# Altium schematic sheet FMCP.SchDoc
size 420 x 297 mm; SheetNumber: 2; SheetTotal: 11; ModifiedBy: -; CheckedDate: -; Title2: Title 2; DivGrp: WUT ISE; Designer: G.Kasprowicz
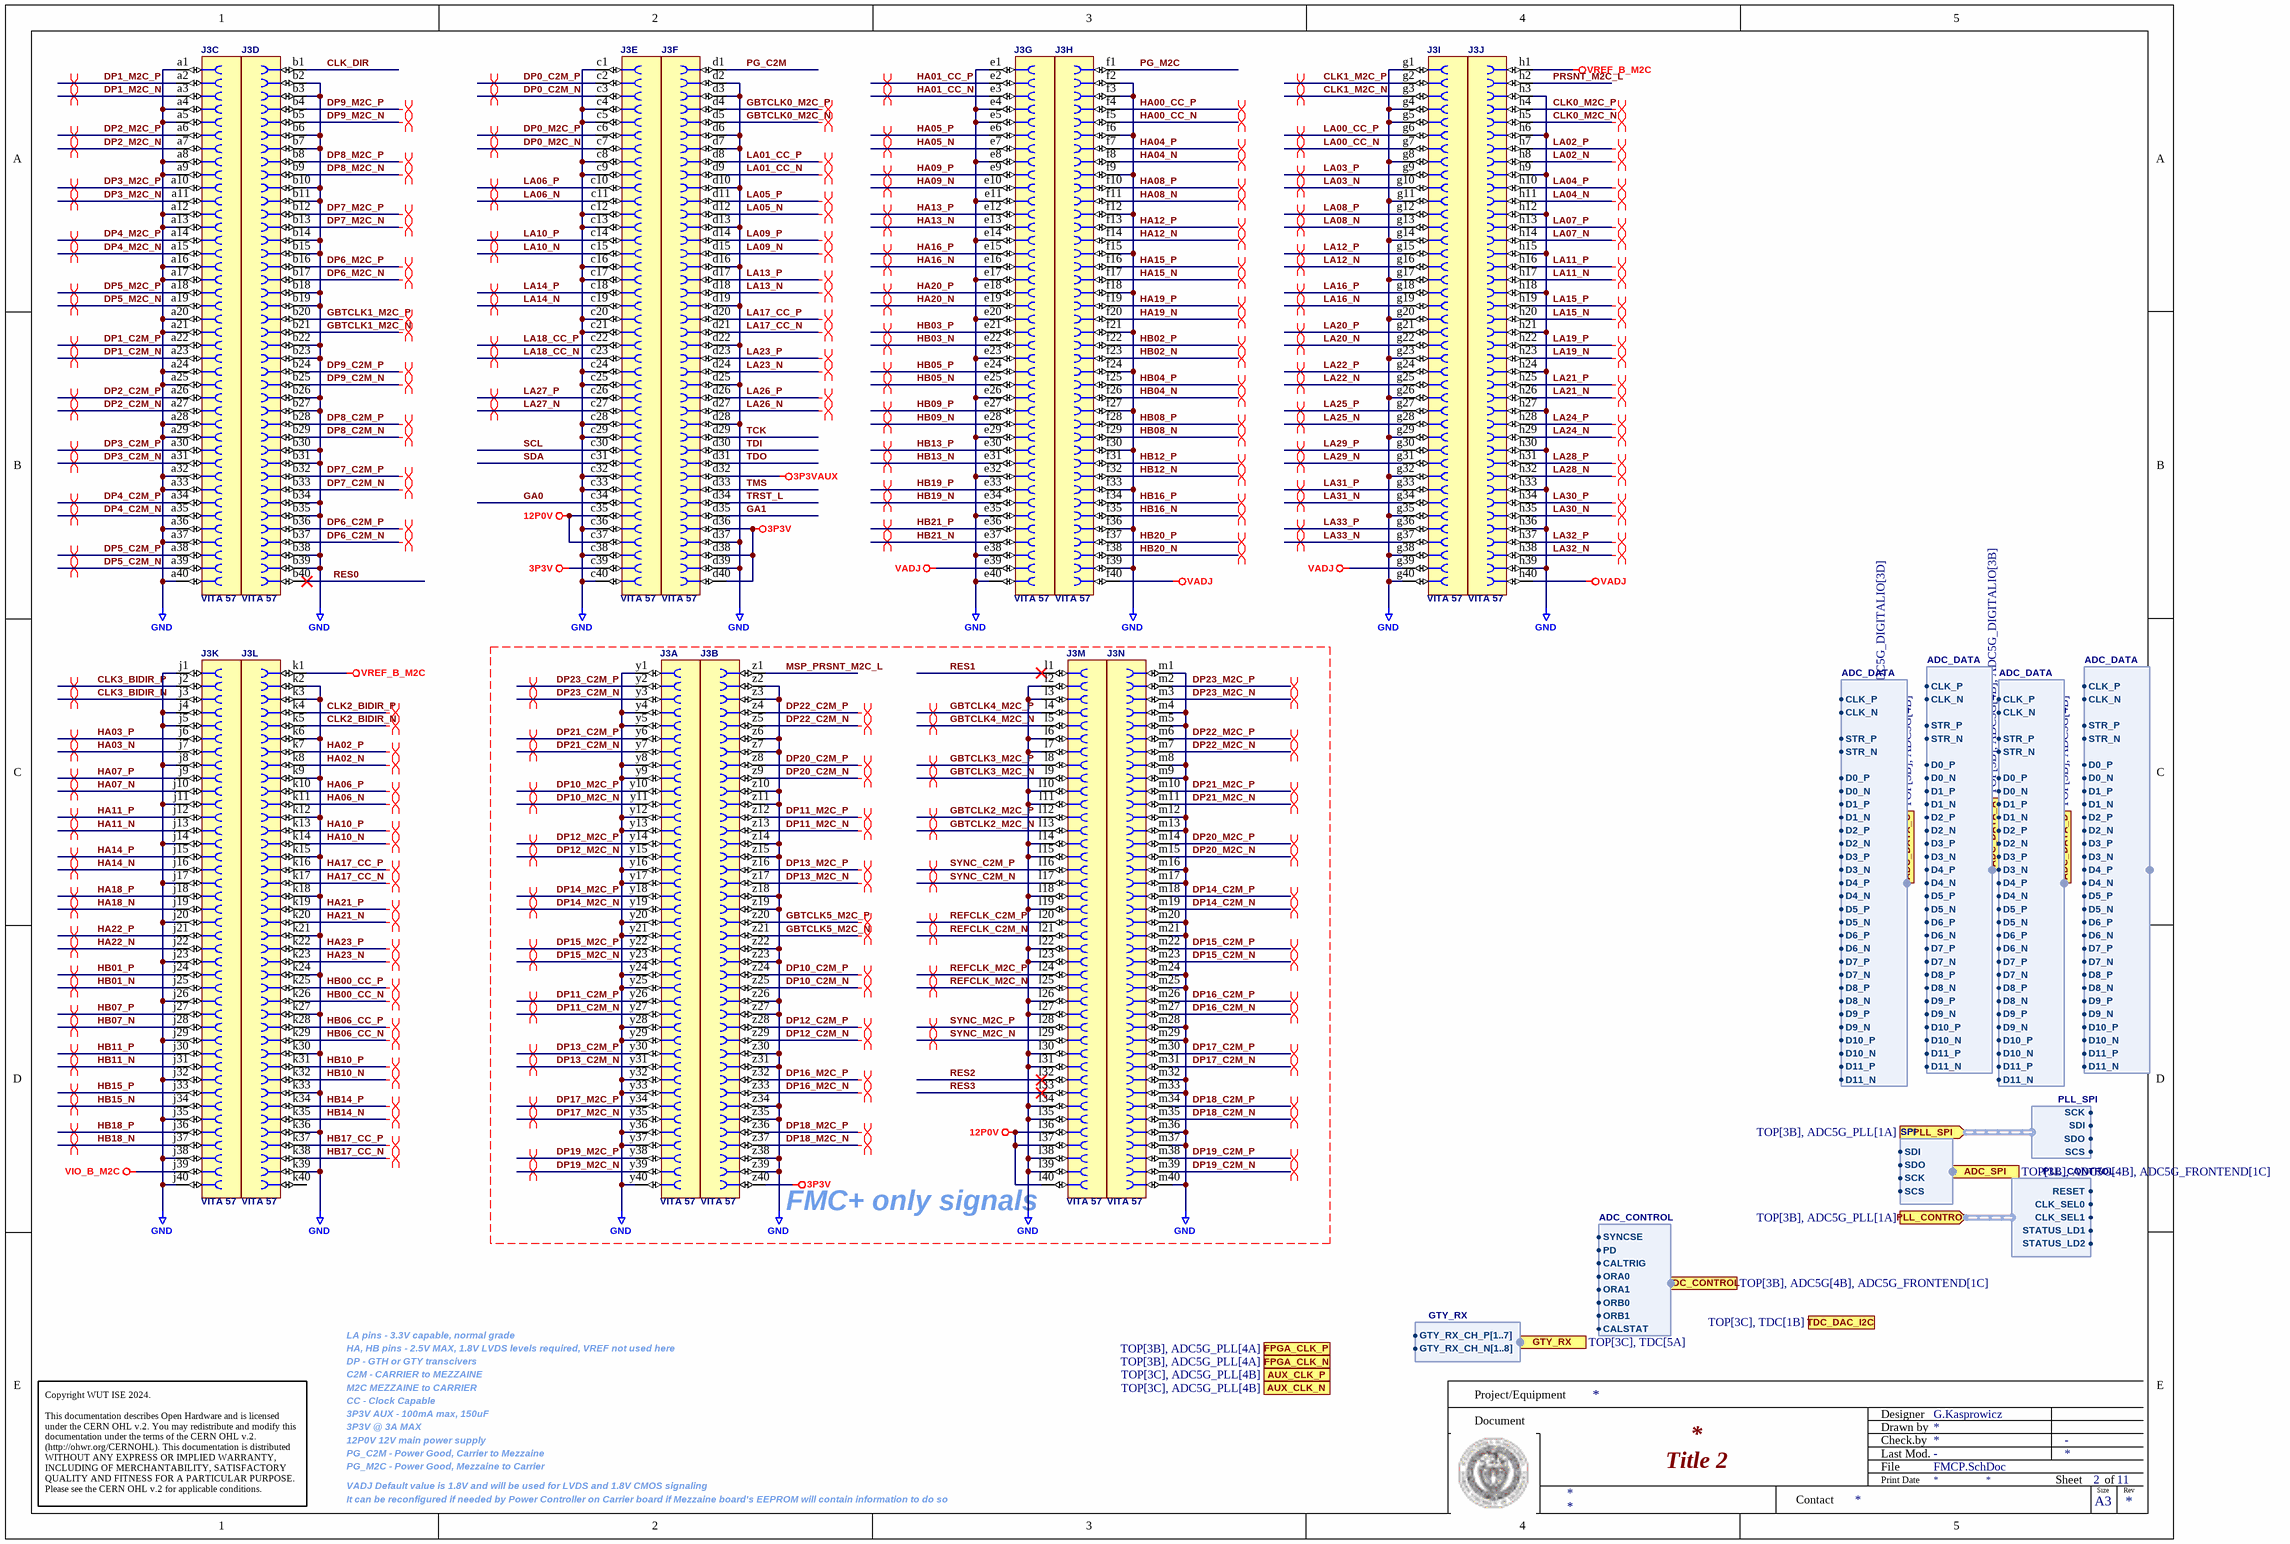
[diagram p0: FMCP.SchDoc]

## Parts
J3  VITA 57  [SAMTEC_ASP-184329-01]  (parts A,B,C,D,E,F,G,H,I,J,K,L,M,N of 14)

## Ports
ADC_CONTROL (in, harness ADC_CONTROL, see TOP[3B], ADC5G[4B], ADC5G_FRONTEND[1C]), ADC_DATA_A (in, harness ADC_DATA, see TOP[3B], ADC5G[4B], ADC5G_DIGITALIO[3B]), ADC_DATA_B (in, harness ADC_DATA, see TOP[3B], ADC5G[4B], ADC5G_DIGITALIO[3D]), ADC_DATA_C (in, harness ADC_DATA, see TOP[3B], ADC5G[4B]), ADC_DATA_D (in, harness ADC_DATA, see TOP[3B], ADC5G[4B]), ADC_SPI (in, harness SPI, see TOP[3B], ADC5G[4B], ADC5G_FRONTEND[1C]), AUX_CLK_N (in, see TOP[3C], ADC5G_PLL[4B]), AUX_CLK_P (in, see TOP[3C], ADC5G_PLL[4B]), FPGA_CLK_N (in, see TOP[3B], ADC5G_PLL[4A]), FPGA_CLK_P (in, see TOP[3B], ADC5G_PLL[4A]), GTY_RX (in, harness GTY_RX, see TOP[3C], TDC[5A]), PLL_CONTROL (in, harness PLL_CONTROL, see TOP[3B], ADC5G_PLL[1A]), PLL_SPI (in, harness PLL_SPI, see TOP[3B], ADC5G_PLL[1A]), TDC_DAC_I2C (harness I2C, see TOP[3C], TDC[1B])

## Harnesses
ADC_DATA: CLK_P, CLK_N, STR_P, STR_N, D0_P, D1_P, D2_P, D3_P, D4_P, D5_P, D6_P, D7_P, D8_P, D9_P, D10_P, D11_P, D11_N, D10_N, D9_N, D8_N, D7_N, D6_N, D5_N, D4_N, D3_N, D2_N, D1_N, D0_N
SPI: SDI, SDO, SCK, SCS
ADC_CONTROL: SYNCSE, PD, CALTRIG, ORA0, ORA1, ORB0, ORB1, CALSTAT
PLL_SPI: SCK, SDI, SDO, SCS
PLL_CONTROL: RESET, CLK_SEL0, CLK_SEL1, STATUS_LD1, STATUS_LD2
GTY_RX: GTY_RX_CH_P[1..7], GTY_RX_CH_N[1..8]

## Nets
3P3V: J3.c39 J3.d36 J3.d38 J3.d40 J3.z40
3P3VAUX: J3.d32
12P0V: J3.c35 J3.c37 J3.l36 J3.l37 J3.l40
GND: J3.a1 J3.a4 J3.a5 J3.a8 J3.a9 J3.a12 J3.a13 J3.a16 J3.a17 J3.a20 J3.a21 J3.a24 J3.a25 J3.a28 J3.a29 J3.a32 J3.a33 J3.a36 J3.a37 J3.a40 J3.b2 J3.b3 J3.b6 J3.b7 J3.b10 J3.b11 J3.b14 J3.b15 J3.b18 J3.b19 J3.b22 J3.b23 J3.b26 J3.b27 J3.b30 J3.b31 J3.b34 J3.b35 J3.b38 J3.b39 J3.c1 J3.c4 J3.c5 J3.c8 J3.c9 J3.c12 J3.c13 J3.c16 J3.c17 J3.c20 J3.c21 J3.c24 J3.c25 J3.c28 J3.c29 J3.c32 J3.c33 J3.c36 J3.c38 J3.c40 J3.d2 J3.d3 J3.d6 J3.d7 J3.d10 J3.d13 J3.d16 J3.d19 J3.d22 J3.d25 J3.d28 J3.d37 J3.d39 J3.e1 J3.e4 J3.e5 J3.e8 J3.e11 J3.e14 J3.e17 J3.e20 J3.e23 J3.e26 J3.e29 J3.e32 J3.e35 J3.e38 J3.e40 J3.f2 J3.f3 J3.f6 J3.f9 J3.f12 J3.f15 J3.f18 J3.f21 J3.f24 J3.f27 J3.f30 J3.f33 J3.f36 J3.f39 J3.g1 J3.g4 J3.g5 J3.g8 J3.g11 J3.g14 J3.g17 J3.g20 J3.g23 J3.g26 J3.g29 J3.g32 J3.g35 J3.g38 J3.g40 J3.h3 J3.h6 J3.h9 J3.h12 J3.h15 J3.h18 J3.h21 J3.h24 J3.h27 J3.h30 J3.h33 J3.h36 J3.h39 J3.j1 J3.j4 J3.j5 J3.j8 J3.j11 J3.j14 J3.j17 J3.j20 J3.j23 J3.j26 J3.j29 J3.j32 J3.j35 J3.j38 J3.j40 J3.k2 J3.k3 J3.k6 J3.k9 J3.k12 J3.k15 J3.k18 J3.k21 J3.k24 J3.k27 J3.k30 J3.k33 J3.k36 J3.k39 J3.l2 J3.l3 J3.l6 J3.l7 J3.l10 J3.l11 J3.l14 J3.l15 J3.l18 J3.l19 J3.l22 J3.l23 J3.l26 J3.l27 J3.l30 J3.l31 J3.l34 J3.l35 J3.l38 J3.l39 J3.m1 J3.m4 J3.m5 J3.m8 J3.m9 J3.m12 J3.m13 J3.m16 J3.m17 J3.m20 J3.m21 J3.m24 J3.m25 J3.m28 J3.m29 J3.m32 J3.m33 J3.m36 J3.m37 J3.m40 J3.y1 J3.y4 J3.y5 J3.y8 J3.y9 J3.y12 J3.y13 J3.y16 J3.y17 J3.y20 J3.y21 J3.y24 J3.y25 J3.y28 J3.y29 J3.y32 J3.y33 J3.y36 J3.y37 J3.y40 J3.z2 J3.z3 J3.z6 J3.z7 J3.z10 J3.z11 J3.z14 J3.z15 J3.z18 J3.z19 J3.z22 J3.z23 J3.z26 J3.z27 J3.z30 J3.z31 J3.z34 J3.z35 J3.z38 J3.z39
VADJ: J3.e39 J3.f40 J3.g39 J3.h40
VIO_B_M2C: J3.j39
VREF_B_M2C: J3.h1 J3.k1
CLK0_M2C_N: J3.h5
CLK0_M2C_P: J3.h4
CLK1_M2C_N: J3.g3
CLK1_M2C_P: J3.g2
CLK2_BIDIR_N: J3.k5
CLK2_BIDIR_P: J3.k4
CLK3_BIDIR_N: J3.j3
CLK3_BIDIR_P: J3.j2
CLK_DIR: J3.b1
DP0_C2M_N: J3.c3
DP0_C2M_P: J3.c2
DP0_M2C_N: J3.c7
DP0_M2C_P: J3.c6
DP1_C2M_N: J3.a23
DP1_C2M_P: J3.a22
DP1_M2C_N: J3.a3
DP1_M2C_P: J3.a2
DP2_C2M_N: J3.a27
DP2_C2M_P: J3.a26
DP2_M2C_N: J3.a7
DP2_M2C_P: J3.a6
DP3_C2M_N: J3.a31
DP3_C2M_P: J3.a30
DP3_M2C_N: J3.a11
DP3_M2C_P: J3.a10
DP4_C2M_N: J3.a35
DP4_C2M_P: J3.a34
DP4_M2C_N: J3.a15
DP4_M2C_P: J3.a14
DP5_C2M_N: J3.a39
DP5_C2M_P: J3.a38
DP5_M2C_N: J3.a19
DP5_M2C_P: J3.a18
DP6_C2M_N: J3.b37
DP6_C2M_P: J3.b36
DP6_M2C_N: J3.b17
DP6_M2C_P: J3.b16
DP7_C2M_N: J3.b33
DP7_C2M_P: J3.b32
DP7_M2C_N: J3.b13
DP7_M2C_P: J3.b12
DP8_C2M_N: J3.b29
DP8_C2M_P: J3.b28
DP8_M2C_N: J3.b9
DP8_M2C_P: J3.b8
DP9_C2M_N: J3.b25
DP9_C2M_P: J3.b24
DP9_M2C_N: J3.b5
DP9_M2C_P: J3.b4
DP10_C2M_N: J3.z25
DP10_C2M_P: J3.z24
DP10_M2C_N: J3.y11
DP10_M2C_P: J3.y10
DP11_C2M_N: J3.y27
DP11_C2M_P: J3.y26
DP11_M2C_N: J3.z13
DP11_M2C_P: J3.z12
DP12_C2M_N: J3.z29
DP12_C2M_P: J3.z28
DP12_M2C_N: J3.y15
DP12_M2C_P: J3.y14
DP13_C2M_N: J3.y31
DP13_C2M_P: J3.y30
DP13_M2C_N: J3.z17
DP13_M2C_P: J3.z16
DP14_C2M_N: J3.m19
DP14_C2M_P: J3.m18
DP14_M2C_N: J3.y19
DP14_M2C_P: J3.y18
DP15_C2M_N: J3.m23
DP15_C2M_P: J3.m22
DP15_M2C_N: J3.y23
DP15_M2C_P: J3.y22
DP16_C2M_N: J3.m27
DP16_C2M_P: J3.m26
DP16_M2C_N: J3.z33
DP16_M2C_P: J3.z32
DP17_C2M_N: J3.m31
DP17_C2M_P: J3.m30
DP17_M2C_N: J3.y35
DP17_M2C_P: J3.y34
DP18_C2M_N: J3.m35
DP18_C2M_P: J3.m34
DP18_M2C_N: J3.z37
DP18_M2C_P: J3.z36
DP19_C2M_N: J3.m39
DP19_C2M_P: J3.m38
DP19_M2C_N: J3.y39
DP19_M2C_P: J3.y38
DP20_C2M_N: J3.z9
DP20_C2M_P: J3.z8
DP20_M2C_N: J3.m15
DP20_M2C_P: J3.m14
DP21_C2M_N: J3.y7
DP21_C2M_P: J3.y6
DP21_M2C_N: J3.m11
DP21_M2C_P: J3.m10
DP22_C2M_N: J3.z5
DP22_C2M_P: J3.z4
DP22_M2C_N: J3.m7
DP22_M2C_P: J3.m6
DP23_C2M_N: J3.y3
DP23_C2M_P: J3.y2
DP23_M2C_N: J3.m3
DP23_M2C_P: J3.m2
GA0: J3.c34
GA1: J3.d35
GBTCLK0_M2C_N: J3.d5
GBTCLK0_M2C_P: J3.d4
GBTCLK1_M2C_N: J3.b21
GBTCLK1_M2C_P: J3.b20
GBTCLK2_M2C_N: J3.l13
GBTCLK2_M2C_P: J3.l12
GBTCLK3_M2C_N: J3.l9
GBTCLK3_M2C_P: J3.l8
GBTCLK4_M2C_N: J3.l5
GBTCLK4_M2C_P: J3.l4
GBTCLK5_M2C_N: J3.z21
GBTCLK5_M2C_P: J3.z20
HA00_CC_N: J3.f5
HA00_CC_P: J3.f4
HA01_CC_N: J3.e3
HA01_CC_P: J3.e2
HA02_N: J3.k8
HA02_P: J3.k7
HA03_N: J3.j7
HA03_P: J3.j6
HA04_N: J3.f8
HA04_P: J3.f7
HA05_N: J3.e7
HA05_P: J3.e6
HA06_N: J3.k11
HA06_P: J3.k10
HA07_N: J3.j10
HA07_P: J3.j9
HA08_N: J3.f11
HA08_P: J3.f10
HA09_N: J3.e10
HA09_P: J3.e9
HA10_N: J3.k14
HA10_P: J3.k13
HA11_N: J3.j13
HA11_P: J3.j12
HA12_N: J3.f14
HA12_P: J3.f13
HA13_N: J3.e13
HA13_P: J3.e12
HA14_N: J3.j16
HA14_P: J3.j15
HA15_N: J3.f17
HA15_P: J3.f16
HA16_N: J3.e16
HA16_P: J3.e15
HA17_CC_N: J3.k17
HA17_CC_P: J3.k16
HA18_N: J3.j19
HA18_P: J3.j18
HA19_N: J3.f20
HA19_P: J3.f19
HA20_N: J3.e19
HA20_P: J3.e18
HA21_N: J3.k20
HA21_P: J3.k19
HA22_N: J3.j22
HA22_P: J3.j21
HA23_N: J3.k23
HA23_P: J3.k22
HB00_CC_N: J3.k26
HB00_CC_P: J3.k25
HB01_N: J3.j25
HB01_P: J3.j24
HB02_N: J3.f23
HB02_P: J3.f22
HB03_N: J3.e22
HB03_P: J3.e21
HB04_N: J3.f26
HB04_P: J3.f25
HB05_N: J3.e25
HB05_P: J3.e24
HB06_CC_N: J3.k29
HB06_CC_P: J3.k28
HB07_N: J3.j28
HB07_P: J3.j27
HB08_N: J3.f29
HB08_P: J3.f28
HB09_N: J3.e28
HB09_P: J3.e27
HB10_N: J3.k32
HB10_P: J3.k31
HB11_N: J3.j31
HB11_P: J3.j30
HB12_N: J3.f32
HB12_P: J3.f31
HB13_N: J3.e31
HB13_P: J3.e30
HB14_N: J3.k35
HB14_P: J3.k34
HB15_N: J3.j34
HB15_P: J3.j33
HB16_N: J3.f35
HB16_P: J3.f34
HB17_CC_N: J3.k38
HB17_CC_P: J3.k37
HB18_N: J3.j37
HB18_P: J3.j36
HB19_N: J3.e34
HB19_P: J3.e33
HB20_N: J3.f38
HB20_P: J3.f37
HB21_N: J3.e37
HB21_P: J3.e36
LA00_CC_N: J3.g7
LA00_CC_P: J3.g6
LA01_CC_N: J3.d9
LA01_CC_P: J3.d8
LA02_N: J3.h8
LA02_P: J3.h7
LA03_N: J3.g10
LA03_P: J3.g9
LA04_N: J3.h11
LA04_P: J3.h10
LA05_N: J3.d12
LA05_P: J3.d11
LA06_N: J3.c11
LA06_P: J3.c10
LA07_N: J3.h14
LA07_P: J3.h13
LA08_N: J3.g13
LA08_P: J3.g12
LA09_N: J3.d15
LA09_P: J3.d14
LA10_N: J3.c15
LA10_P: J3.c14
LA11_N: J3.h17
LA11_P: J3.h16
LA12_N: J3.g16
LA12_P: J3.g15
LA13_N: J3.d18
LA13_P: J3.d17
LA14_N: J3.c19
LA14_P: J3.c18
LA15_N: J3.h20
LA15_P: J3.h19
LA16_N: J3.g19
LA16_P: J3.g18
LA17_CC_N: J3.d21
LA17_CC_P: J3.d20
LA18_CC_N: J3.c23
LA18_CC_P: J3.c22
LA19_N: J3.h23
LA19_P: J3.h22
LA20_N: J3.g22
LA20_P: J3.g21
LA21_N: J3.h26
LA21_P: J3.h25
LA22_N: J3.g25
LA22_P: J3.g24
LA23_N: J3.d24
LA23_P: J3.d23
LA24_N: J3.h29
LA24_P: J3.h28
LA25_N: J3.g28
LA25_P: J3.g27
LA26_N: J3.d27
LA26_P: J3.d26
LA27_N: J3.c27
LA27_P: J3.c26
LA28_N: J3.h32
LA28_P: J3.h31
LA29_N: J3.g31
LA29_P: J3.g30
LA30_N: J3.h35
LA30_P: J3.h34
LA31_N: J3.g34
LA31_P: J3.g33
LA32_N: J3.h38
LA32_P: J3.h37
LA33_N: J3.g37
LA33_P: J3.g36
MSP_PRSNT_M2C_L: J3.z1
PG_C2M: J3.d1
PG_M2C: J3.f1
PRSNT_M2C_L: J3.h2
REFCLK_C2M_N: J3.l21
REFCLK_C2M_P: J3.l20
REFCLK_M2C_N: J3.l25
REFCLK_M2C_P: J3.l24
RES0: J3.b40
RES1: J3.l1
RES2: J3.l32
RES3: J3.l33
SCL: J3.c30
SDA: J3.c31
SYNC_C2M_N: J3.l17
SYNC_C2M_P: J3.l16
SYNC_M2C_N: J3.l29
SYNC_M2C_P: J3.l28
TCK: J3.d29
TDI: J3.d30
TDO: J3.d31
TMS: J3.d33
TRST_L: J3.d34

Not connected (* = marked no-connect by the designer): J3 k40

## Layout directives
differential pair: CLK0_M2C_N, CLK0_M2C_P, CLK1_M2C_N, CLK1_M2C_P, CLK2_BIDIR_N, CLK2_BIDIR_P, CLK3_BIDIR_N, CLK3_BIDIR_P, DP0_C2M_N, DP0_C2M_P, DP0_M2C_N, DP0_M2C_P, DP1_C2M_N, DP1_C2M_P, DP1_M2C_N, DP1_M2C_P, DP2_C2M_N, DP2_C2M_P, DP2_M2C_N, DP2_M2C_P, DP3_C2M_N, DP3_C2M_P, DP3_M2C_N, DP3_M2C_P, DP4_C2M_N, DP4_C2M_P, DP4_M2C_N, DP4_M2C_P, DP5_C2M_N, DP5_C2M_P, DP5_M2C_N, DP5_M2C_P, DP6_C2M_N, DP6_C2M_P, DP6_M2C_N, DP6_M2C_P, DP7_C2M_N, DP7_C2M_P, DP7_M2C_N, DP7_M2C_P, DP8_C2M_N, DP8_C2M_P, DP8_M2C_N, DP8_M2C_P, DP9_C2M_N, DP9_C2M_P, DP9_M2C_N, DP9_M2C_P, DP10_C2M_N, DP10_C2M_P, DP10_M2C_N, DP10_M2C_P, DP11_C2M_N, DP11_C2M_P, DP11_M2C_N, DP11_M2C_P, DP12_C2M_N, DP12_C2M_P, DP12_M2C_N, DP12_M2C_P, DP13_C2M_N, DP13_C2M_P, DP13_M2C_N, DP13_M2C_P, DP14_C2M_N, DP14_C2M_P, DP14_M2C_N, DP14_M2C_P, DP15_C2M_N, DP15_C2M_P, DP15_M2C_N, DP15_M2C_P, DP16_C2M_N, DP16_C2M_P, DP16_M2C_N, DP16_M2C_P, DP17_C2M_N, DP17_C2M_P, DP17_M2C_N, DP17_M2C_P, DP18_C2M_N, DP18_C2M_P, DP18_M2C_N, DP18_M2C_P, DP19_C2M_N, DP19_C2M_P, DP19_M2C_N, DP19_M2C_P, DP20_C2M_N, DP20_C2M_P, DP20_M2C_N, DP20_M2C_P, DP21_C2M_N, DP21_C2M_P, DP21_M2C_N, DP21_M2C_P, DP22_C2M_N, DP22_C2M_P, DP22_M2C_N, DP22_M2C_P, DP23_C2M_N, DP23_C2M_P, DP23_M2C_N, DP23_M2C_P, GBTCLK0_M2C_N, GBTCLK0_M2C_P, GBTCLK1_M2C_N, GBTCLK1_M2C_P, GBTCLK2_M2C_N, GBTCLK2_M2C_P, GBTCLK3_M2C_N, GBTCLK3_M2C_P, GBTCLK4_M2C_N, GBTCLK4_M2C_P, GBTCLK5_M2C_N, GBTCLK5_M2C_P, HA00_CC_N, HA00_CC_P, HA01_CC_N, HA01_CC_P, HA02_N, HA02_P, HA03_N, HA03_P, HA04_N, HA04_P, HA05_N, HA05_P, HA06_N, HA06_P, HA07_N, HA07_P, HA08_N, HA08_P, HA09_N, HA09_P, HA10_N, HA10_P, HA11_N, HA11_P, HA12_N, HA12_P, HA13_N, HA13_P, HA14_N, HA14_P, HA15_N, HA15_P, HA16_N, HA16_P, HA17_CC_N, HA17_CC_P, HA18_N, HA18_P, HA19_N, HA19_P, HA20_N, HA20_P, HA21_N, HA21_P, HA22_N, HA22_P, HA23_N, HA23_P, HB00_CC_N, HB00_CC_P, HB01_N, HB01_P, HB02_N, HB02_P, HB03_N, HB03_P, HB04_N, HB04_P, HB05_N, HB05_P, HB06_CC_N, HB06_CC_P, HB07_N, HB07_P, HB08_N, HB08_P, HB09_N, HB09_P, HB10_N, HB10_P, HB11_N, HB11_P, HB12_N, HB12_P, HB13_N, HB13_P, HB14_N, HB14_P, HB15_N, HB15_P, HB16_N, HB16_P, HB17_CC_N, HB17_CC_P, HB18_N, HB18_P, HB19_N, HB19_P, HB20_N, HB20_P, HB21_N, HB21_P, LA00_CC_N, LA00_CC_P, LA01_CC_N, LA01_CC_P, LA02_N, LA02_P, LA03_N, LA03_P, LA04_N, LA04_P, LA05_N, LA05_P, LA06_N, LA06_P, LA07_N, LA07_P, LA08_N, LA08_P, LA09_N, LA09_P, LA10_N, LA10_P, LA11_N, LA11_P, LA12_N, LA12_P, LA13_N, LA13_P, LA14_N, LA14_P, LA15_N, LA15_P, LA16_N, LA16_P, LA17_CC_N, LA17_CC_P, LA18_CC_N, LA18_CC_P, LA19_N, LA19_P, LA20_N, LA20_P, LA21_N, LA21_P, LA22_N, LA22_P, LA23_N, LA23_P, LA24_N, LA24_P, LA25_N, LA25_P, LA26_N, LA26_P, LA27_N, LA27_P, LA28_N, LA28_P, LA29_N, LA29_P, LA30_N, LA30_P, LA31_N, LA31_P, LA32_N, LA32_P, LA33_N, LA33_P, REFCLK_C2M_N, REFCLK_C2M_P, REFCLK_M2C_N, REFCLK_M2C_P, SYNC_C2M_N, SYNC_C2M_P, SYNC_M2C_N, SYNC_M2C_P

## Notes on the sheet
- (near J3) FMC+ only signals
- LA pins - 3.3V capable, normal grade
- HA, HB pins - 2.5V MAX, 1.8V LVDS levels required, VREF not used here
- DP - GTH or GTY transcivers
- C2M - CARRIER to MEZZAINE
- M2C MEZZAINE to CARRIER
- CC - Clock Capable
- 3P3V AUX - 100mA max, 150uF
- 3P3V @ 3A MAX
- 12P0V 12V main power supply
- PG_C2M - Power Good, Carrier to Mezzaine
- PG_M2C - Power Good, Mezzaine to Carrier
- VADJ Default value is 1.8V and will be used for LVDS and 1.8V CMOS signaling
- It can be reconfigured if needed by Power Controller on Carrier board if Mezzaine board's EEPROM will contain information to do so
- Project/Equipment
- Document
- Designer
- Drawn by
- Check.by
- Copyright WUT ISE 2024.
  This documentation describes Open Hardware and is licensed under the CERN OHL v.2. You may redistribute and modify this documentation under the terms of the CERN OHL v.2. (http://ohwr.org/CERNOHL). This documentation is distributed WITHOUT ANY EXPRESS OR IMPLIED WARRANTY, INCLUDING OF MERCHANTABILITY, SATISFACTORY QUALITY AND FITNESS FOR A PARTICULAR PURPOSE. Please see the CERN OHL v.2 for applicable conditions.
- Contact
- File
- Last Mod.
- Print Date
- Sheet
- Size
- A3
- of
- Rev

## Library data of the parts
J3 = SAMTEC_ASP-184329-01: Connector VITA 57, 560 Female Contacts in 14 Rows (yzabcdefghjlm); Part Description: 560 Contacts (14 Rows yzabcdefghjklm) Surface Mount Female Connector, VITA 57.4; Manufacturer: SAMTEC; PressFit: No; Part Number: SAMTEC_ASP-184329-01; Component Kind: Standard; Component Type: Standard; Pin Count: 560; Family: VITA 57; Mounted: Yes; Socket: No; SMD: Yes; Sense: No; Status: None; Manufacturer Part Number: ASP-184329-01; ComponentHeight: 6.55mm; HelpURL: \\cern.ch\dfs\Applications\Altium\Datasheets\SAMTEC_ASP-184329-01.pdf; Author: CERN DEM JMW; CreateDate: 24.01.2018; LatestRevisionDate: 24.01.2018